# EasyEDA Pro project 3SE_24_Power_Rune.eprj, board Armour (continued)
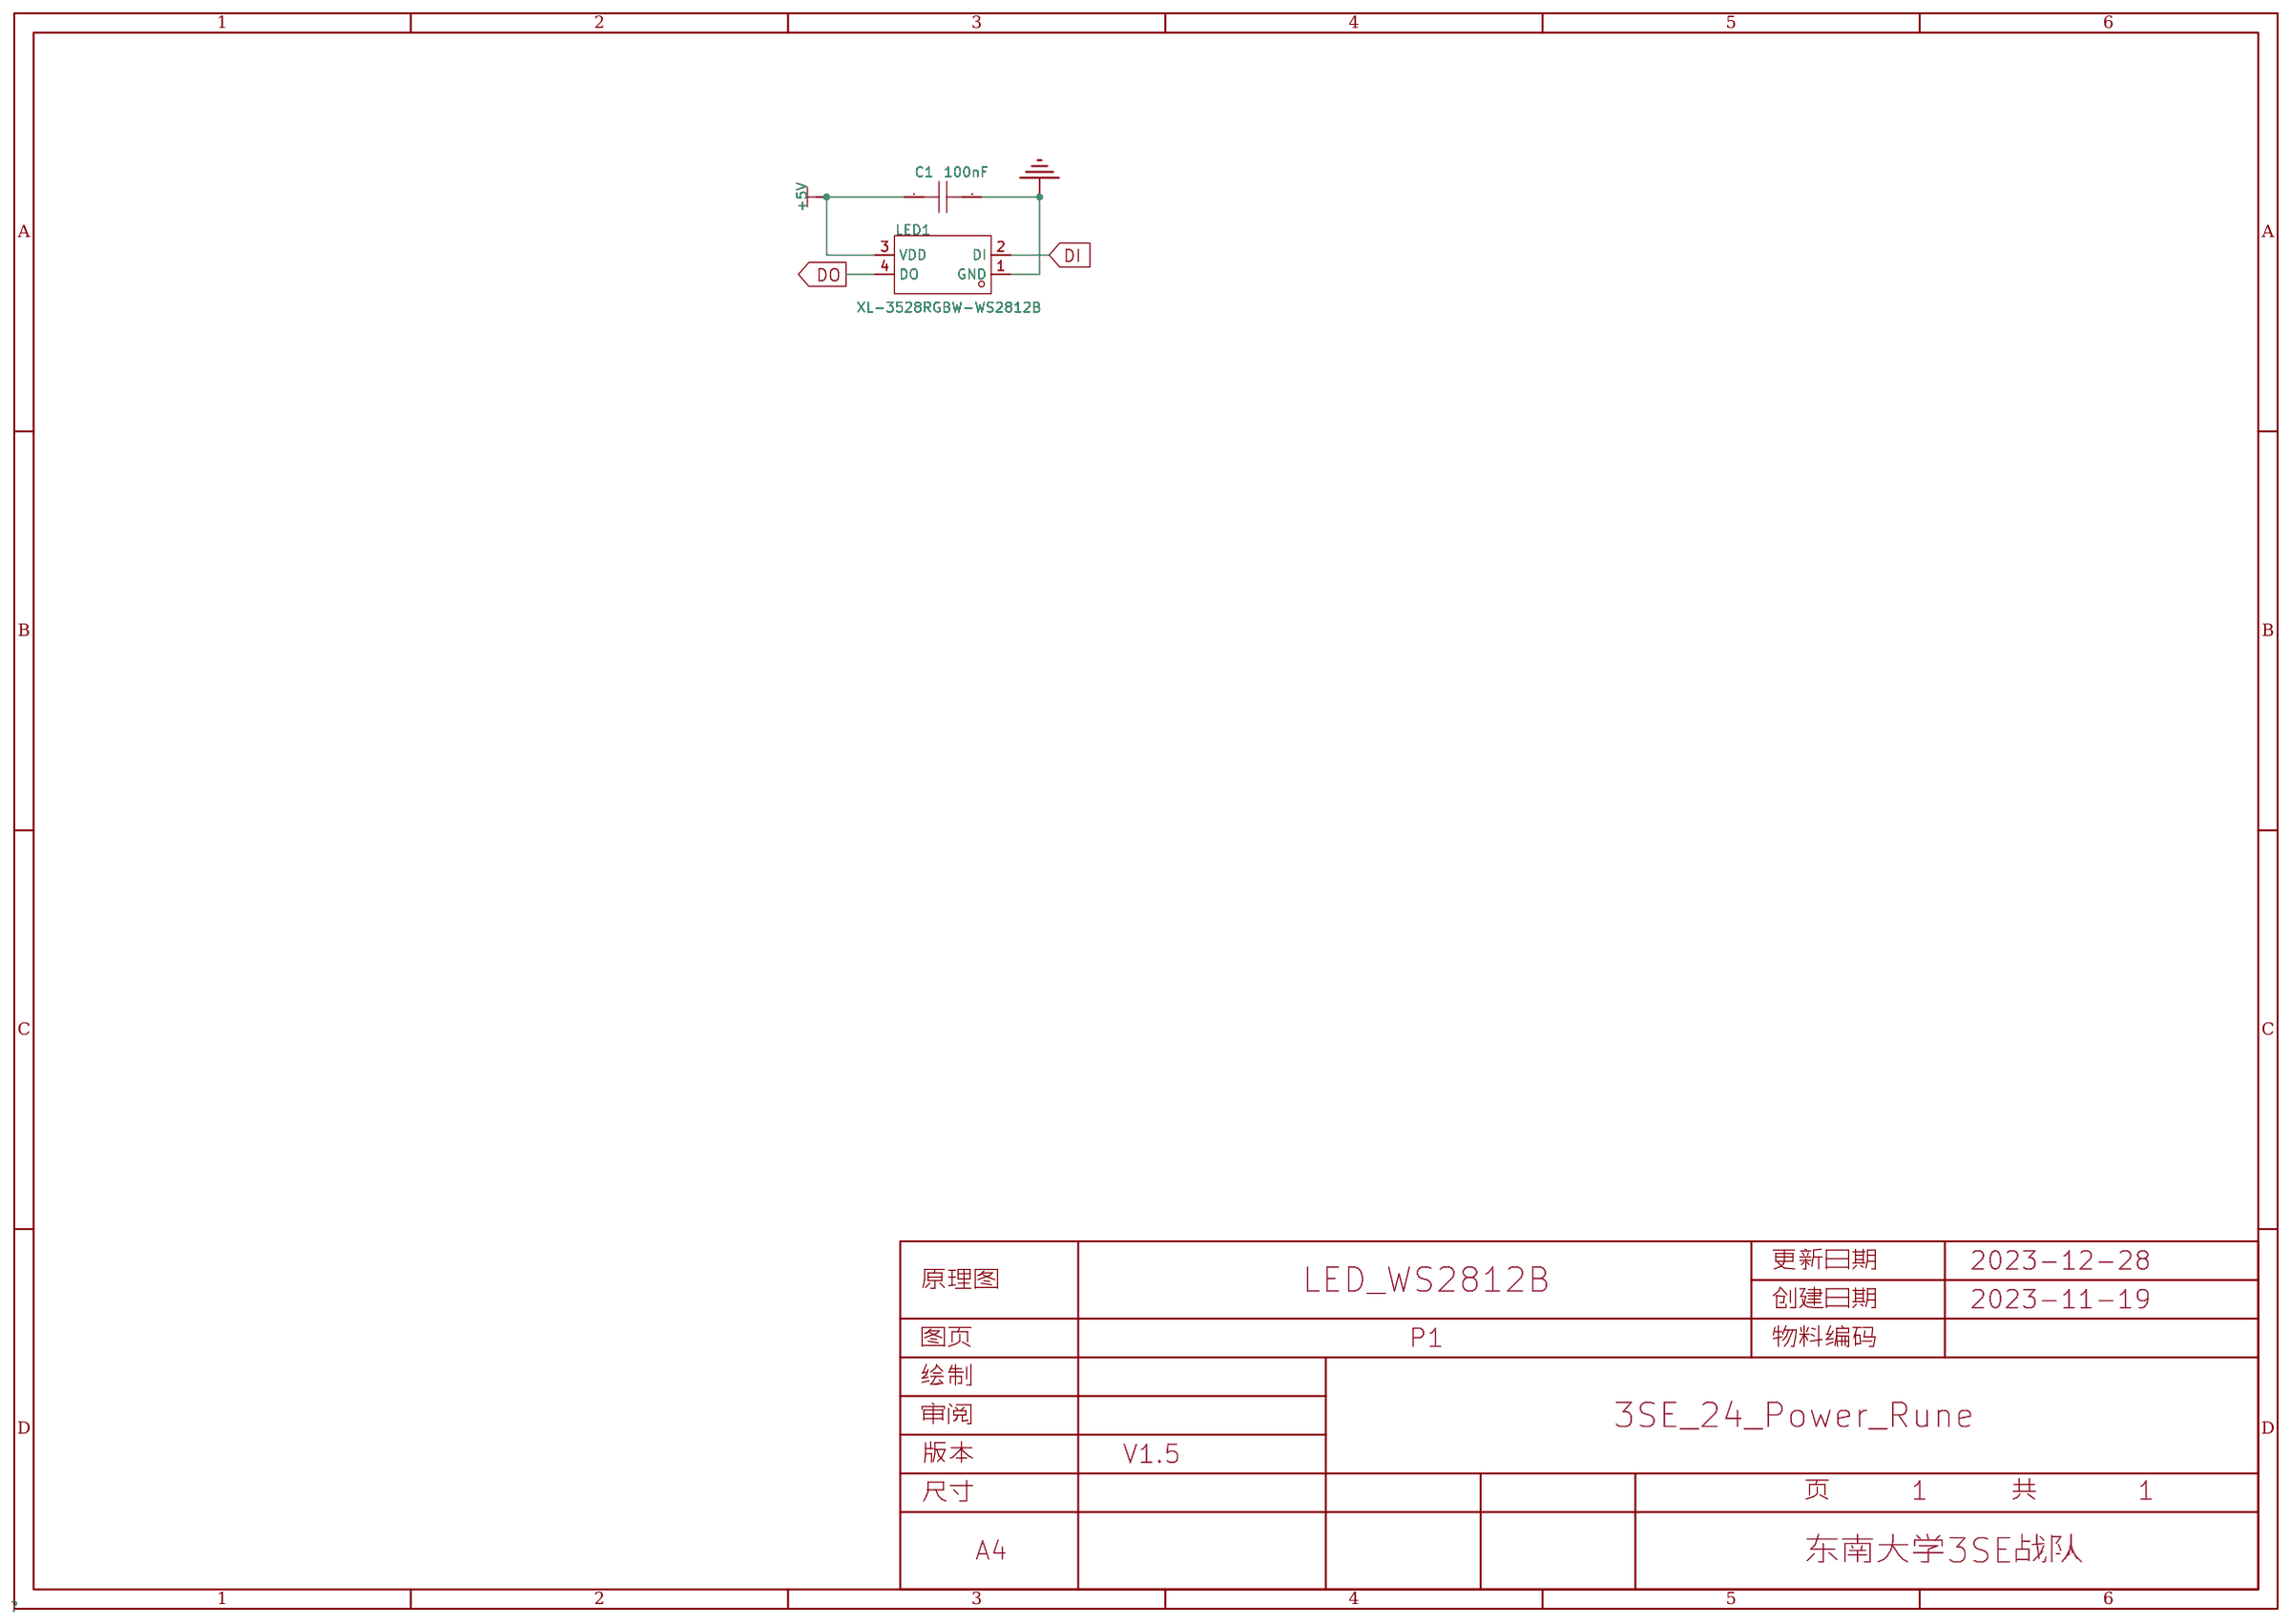
[diagram p0: schematic sheet]
## Placement (name value [footprint] x y rotation side) (continued)
SW3  DSHP01TSGER  [SW-SMD_DSHP01TSGER]  350.7 193.87 180 top
U1  XL4016E1  [TO-220-5_L15.5-W10.5-P1.70-BL_ON_CASE-314A-03]  24.2 212.38 180 top
U2  AMS1117-3.3  [SOT-223-4_L6.5-W3.5-P2.30-LS7.0-BR]  334.48 206.06 180 top
U3  ESP32-S3-WROOM-1-N8R2  [WIRELM-SMD_ESP32-S3-WROOM-1]  341.13 226.19 0 top
U4  74HC4051D,653  [SOIC-16_L9.9-W3.9-P1.27-LS6.0-BL]  341.79 196.72 0 top
USB1  TYPE-C 16PIN 2MD(073)  [USB-C-SMD_TYPE-C-6PIN-2MD-073]  350.37 207.98 90 top
X1  32.768kHz  [FC-135R_L3.2-W1.5]  330.35 225.43 270 top

## Footprints (pads in the part's own frame, mm; a bottom-side part is the same pattern mirrored in y, then rotated)
C0603
  rect 0.8x0.9 smd: 1(-0.7,0) 2(0.7,0)
CAP-SMD_BD10.0-L10.3-W10.3-LS11.0-FD
  rect 4.5x1.65 smd: 1(-4.5,0) 2(4.5,0)
CAP-SMD_BD12.5-L13.0-W13.0-RD
  rect 5x1.6 smd: 1(5.8,0) 2(-5.8,0)
CONN-SMD_2P-P1.25_HCTL_HC-GH-2PWTKK
  rect 0.7x1.8 smd: 1(-0.625,1.75) 2(0.625,1.75)
  rect 1x2.7 smd: 3(2.455,-1.75) 4(-2.455,-1.75)
CONN-SMD_4P-P1.25_XUNPU_WAFER-GH1.25-4PWB
  rect 0.6x1.7 smd: 1(-1.875,1.575) 2(-0.625,1.575) 3(0.625,1.575) 4(1.875,1.575)
  rect 1x2.8 smd: 5(3.725,-1.575) 6(-3.725,-1.575)
CONN-TH_SM03B-GHS-TB-LF-SN
  rect 0.6x1.7 smd: 1(-1.25,1.854) 2(0,1.854) 3(1.25,1.854)
  rect 1x2.2 smd: 4(3.1,-1.854) 5(-3.1,-1.854)
CONN-TH_SM03B-GHS-TB-LF-SN#2
  rect 0.6x1.7 smd: 1(-1.25,1.854) 2(0,1.854) 3(1.25,1.854)
  rect 1x2.2 smd: 4(3.1,-1.854) 5(-3.1,-1.854)
CONN-TH_XT30PW-F-1
  round 2.5 hole 1.7: 1(-2.5,2.5) 2(2.5,2.5)
  round 1.8 hole 1: 3(5.5,-2.5) 4(-5.5,-2.5)
CONN-TH_XT30PW-M
  round 2.5 hole 1.8: 1(-2.5,5) 2(2.5,5)
  round 1.8 hole 1.1: 3(5.5,-5) 4(-5.5,-5)
FC-135R_L3.2-W1.5
  rect 1x1.8 smd: 1(-1.25,0) 2(1.25,0)
IND-SMD_L17.5-W17.2
  rect 4x14 smd: 1(-8,0) 2(8,0)
LED0603-RD_RED
  rect 0.8x0.8 smd: 1(-0.799,-0.004) 2(0.799,0.004)
LED-SMD_4P-L3.5-W2.8-BR-1
  rect 1.2x0.9 smd: 1(1.5,-0.75) 2(1.5,0.75) 3(-1.5,0.75) 4(-1.5,-0.75)
R0603
  rect 0.806x0.864 smd: 1(-0.753,0) 2(0.753,0)
SMB_L4.6-W3.6-LS5.3-BI
  rect 2.047x2.241 smd: 1(-2.591,0) 2(2.591,0)
SOD-323_L1.7-W1.3-LS2.6-BI
  rect 0.83x0.63 smd: 1(-1.14,0) 2(1.14,0)
SOIC-16_L9.9-W3.9-P1.27-LS6.0-BL
  oval 0.602x1.971 smd: 1(-4.445,-2.736) 2(-3.175,-2.736) 3(-1.905,-2.736) 4(-0.635,-2.736) 5(0.635,-2.736) 6(1.905,-2.736) 7(3.175,-2.736) 8(4.445,-2.736) 9(4.445,2.736) 10(3.175,2.736) 11(1.905,2.736) 12(0.635,2.736) 13(-0.635,2.736) 14(-1.905,2.736) 15(-3.175,2.736) 16(-4.445,2.736)
SOT-23-6_L2.9-W1.6-P0.95-LS2.8-BL
  rect 0.532x1.072 smd: 1(-0.95,-1.149) 2(0,-1.149) 3(0.95,-1.149) 4(0.95,1.149) 5(0,1.149) 6(-0.95,1.149)
SOT-223-4_L6.5-W3.5-P2.30-LS7.0-BR
  rect 2.47x0.98 smd: 1(2.835,-2.3) 2(2.835,0) 3(2.835,2.3)
  rect 2.47x3.6 smd: 4(-2.835,0)
SW-SMD_DSHP01TSGER
  rect 0.76x1.27 smd: 1(0,3.81) 2(0,-3.81)
SW-SMD_L6.0-W3.3-LS8.0
  rect 1.9x1.5 smd: 1(-4,0) 2(4,0)
Test-Point-0.5mm
  round 0.5 smd: 1(0,0)
TO-220-5_L15.5-W10.5-P1.70-BL_ON_CASE-314A-03
  rect 1.8x1.8 hole 1.2: 1(-3.4,-9.45)
  round 1.8 hole 1.2: 2(-1.7,-5.35) 3(0,-9.45) 4(1.7,-5.35) 5(3.4,-9.45)
  round 4 hole 4: 6(0,9.45)
  rect 11x6.5 smd: 6(0,9.45)
TO-277_3P-L5.4-W4.0-LS6.5-TR
  rect 1.29x1.423 smd: 1(2.054,0.92) 3(2.054,-0.92)
  rect 5.2x3.8 smd: 2(-2.054,0)
USB-C-SMD_TYPE-C-6PIN-2MD-073
  rect 0.6x1.1 smd: 1(-3.2,2.375) 2(-2.4,2.375) 11(2.4,2.375) 12(3.2,2.375)
  rect 0.3x1.1 smd: 3(-1.75,2.375) 4(-1.25,2.375) 5(-0.75,2.375) 6(-0.25,2.375) 7(0.25,2.375) 8(0.75,2.375) 9(1.25,2.375) 10(1.75,2.375)
  oval 1.2x2 hole 0.6x1.5: 13(-4.325,1.825) 14(4.325,1.825)
  oval 1.2x1.8 hole 0.6x1.2: 13(-4.325,-2.375) 14(4.325,-2.375)
WIRELM-SMD_ESP32-S3-WROOM-1
  rect 1.5x0.9 smd: 1(-8.75,8.895) 2(-8.75,7.625) 3(-8.75,6.355) 4(-8.75,5.085) 5(-8.75,3.815) 6(-8.75,2.545) 7(-8.75,1.275) 8(-8.75,0.005) 9(-8.75,-1.265) 10(-8.75,-2.535) 11(-8.75,-3.805) 12(-8.75,-5.075) 13(-8.75,-6.345) 14(-8.75,-7.615) 27(8.75,-7.615) 28(8.75,-6.345) 29(8.75,-5.075) 30(8.75,-3.805) 31(8.75,-2.535) 32(8.75,-1.265) 33(8.75,0.005) 34(8.75,1.275) 35(8.75,2.545) 36(8.75,3.815) 37(8.75,5.085) 38(8.75,6.355) 39(8.75,7.625) 40(8.75,8.895)
  rect 0.9x1.5 smd: 15(-6.985,-8.895) 16(-5.715,-8.895) 17(-4.445,-8.895) 18(-3.175,-8.895) 19(-1.905,-8.895) 20(-0.635,-8.895) 21(0.635,-8.895) 22(1.905,-8.895) 23(3.175,-8.895) 24(4.445,-8.895) 25(5.715,-8.895) 26(6.985,-8.865)
  rect 0.9x0.9 smd: 41(-2.9,2.575) 41(-2.9,1.175) 41(-2.9,-0.225) 41(-1.5,2.575) 41(-1.5,1.175) 41(-1.5,-0.225) 41(-0.1,2.575) 41(-0.1,1.175) 41(-0.1,-0.225)
热插拔轴座
  rect 1.981x1.981 smd far side: 1(-5.995,-5.055) 2(7.466,-2.515)
  round 3.304 hole 3: 1(-2.439,-5.056) 2(3.91,-2.515)

## Nets
+3V3: 3V3.1 C434.1 C435.2 C445.1 C446.1 C448.1 R2.2 R3.2 R5.2 R8.2 R11.2 R12.2 R14.2 R17.2 R18.1 R25.2 R26.2 R28.1 R30.2 R31.1 U2.2 U2.4 U3.2 U4.16
+5V: 5V.1 C1.1 C2.1 C3.1 C4.1 C5.1 C6.1 C7.1 C8.1 C9.1 C10.1 C11.1 C12.1 C13.1 C14.1 C15.1 C16.1 C17.1 C18.1 C19.1 C20.1 C21.1 C22.1 C23.1 C24.1 C25.1 C26.1 C27.1 C28.1 C29.1 C30.1 C31.1 C32.1 C33.1 C34.1 C35.1 C36.1 C37.1 C38.1 C39.1 C40.1 C41.1 C42.1 C43.1 C44.1 C45.1 C46.1 C47.1 C48.1 C49.1 C50.1 C51.1 C52.1 C53.1 C54.1 C55.1 C56.1 C57.1 C58.1 C59.1 C60.1 C61.1 C62.1 C63.1 C64.1 C65.1 C66.1 C67.1 C68.1 C69.1 C70.1 C71.1 C72.1 C73.1 C74.1 C75.1 C76.1 C77.1 C78.1 C79.1 C80.1 C81.1 C82.1 C83.1 C84.1 C85.1 C86.1 C87.1 C88.1 C89.1 C90.1 C91.1 C92.1 C93.1 C94.1 C95.1 C96.1 C97.1 C98.1 C99.1 C100.1 C101.1 C102.1 C103.1 C104.1 C105.1 C106.1 C107.1 C108.1 C109.1 C110.1 C111.1 C112.1 C113.1 C114.1 C115.1 C116.1 C117.1 C118.1 C119.1 C120.1 C121.1 C122.1 C123.1 C124.1 C125.1 C126.1 C127.1 C128.1 C129.1 C130.1 C131.1 C132.1 C133.1 C134.1 C135.1 C136.1 C137.1 C138.1 C139.1 C140.1 C141.1 C142.1 C143.1 C144.1 C145.1 C146.1 C147.1 C148.1 C149.1 C150.1 C151.1 C152.1 C153.1 C154.1 C155.1 C156.1 C157.1 C158.1 C159.1 C160.1 C161.1 C162.1 C163.1 C164.1 C165.1 C166.1 C167.1 C168.1 C169.1 C170.1 C171.1 C172.1 C173.1 C174.1 C175.1 C176.1 C177.1 C178.1 C179.1 C180.1 C181.1 C182.1 C183.1 C184.1 C185.1 C186.1 C187.1 C188.1 C189.1 C190.1 C191.1 C192.1 C193.1 C194.1 C195.1 C196.1 C197.1 C198.1 C199.1 C200.1 C201.1 C202.1 C203.1 C204.1 C205.1 C206.1 C207.1 C208.1 C209.1 C210.1 C211.1 C212.1 C213.1 C214.1 C215.1 C216.1 C217.1 C218.1 C219.1 C220.1 C221.1 C222.1 C223.1 C224.1 C225.1 C226.1 C227.1 C228.1 C229.1 C230.1 C231.1 C232.1 C233.1 C234.1 C235.1 C236.1 C237.1 C238.1 C239.1 C240.1 C241.1 C242.1 C243.1 C244.1 C245.1 C246.1 C247.1 C248.1 C249.1 C250.1 C251.1 C252.1 C253.1 C254.1 C255.1 C256.1 C257.1 C258.1 C259.1 C260.1 C261.1 C262.1 C263.1 C264.1 C265.1 C266.1 C267.1 C268.1 C269.1 C270.1 C271.1 C272.1 C273.1 C274.1 C275.1 C276.1 C277.1 C278.1 C279.1 C280.1 C281.1 C282.1 C283.1 C284.1 C285.1 C286.1 C287.1 C288.1 C289.1 C290.1 C291.1 C292.1 C293.1 C294.1 C295.1 C296.1 C297.1 C298.1 C299.1 C300.1 C301.1 C302.1 C303.1 C304.1 C305.1 C306.1 C307.1 C308.1 C309.1 C310.1 C311.1 C312.1 C313.1 C314.1 C315.1 C316.1 C317.1 C318.1 C319.1 C320.1 C321.1 C322.1 C323.1 C324.1 C325.1 C326.1 C327.1 C328.1 C329.1 C330.1 C331.1 C332.1 C333.1 C334.1 C335.1 C336.1 C337.1 C338.1 C339.1 C340.1 C341.1 C342.1 C343.1 C344.1 C345.1 C346.1 C347.1 C348.1 C349.1 C350.1 C351.1 C352.1 C353.1 C354.1 C355.1 C356.1 C357.1 C358.1 C359.1 C360.1 C361.1 C362.1 C363.1 C364.1 C365.1 C366.1 C367.1 C368.1 C369.1 C370.1 C371.1 C372.1 C373.1 C374.1 C375.1 C376.1 C377.1 C378.1 C379.1 C380.1 C381.1 C382.1 C383.1 C384.1 C385.1 C386.1 C387.1 C388.1 C389.1 C390.1 C391.1 C392.1 C393.1 C394.1 C395.1 C396.1 C397.1 C398.1 C399.1 C400.1 C401.1 C402.1 C403.1 C404.1 C405.1 C406.1 C407.1 C408.1 C409.1 C410.1 C411.1 C412.1 C413.1 C414.1 C415.1 C416.1 C417.1 C418.1 C419.1 C420.1 C421.1 C422.1 C423.1 C424.1 C425.1 C426.1 C427.1 C428.1 C429.1 C430.1 C436.1 C437.2 C438.2 C439.1 C440.2 C458.1 C459.1 C460.1 C461.1 C462.1 C463.1 CN2.1 CN3.1 CN5.1 CN6.4 D3.2 D4.5 L1.2 LED1.3 LED2.3 LED3.3 LED4.3 LED5.3 LED6.3 LED7.3 LED8.3 LED9.3 LED10.3 LED11.3 LED12.3 LED13.3 LED14.3 LED15.3 LED16.3 LED17.3 LED18.3 LED19.3 LED20.3 LED21.3 LED22.3 LED23.3 LED24.3 LED25.3 LED26.3 LED27.3 LED28.3 LED29.3 LED30.3 LED31.3 LED32.3 LED33.3 LED34.3 LED35.3 LED36.3 LED37.3 LED38.3 LED39.3 LED40.3 LED41.3 LED42.3 LED43.3 LED44.3 LED45.3 LED46.3 LED47.3 LED48.3 LED49.3 LED50.3 LED51.3 LED52.3 LED53.3 LED54.3 LED55.3 LED56.3 LED57.3 LED58.3 LED59.3 LED60.3 LED61.3 LED62.3 LED63.3 LED64.3 LED65.3 LED66.3 LED67.3 LED68.3 LED69.3 LED70.3 LED71.3 LED72.3 LED73.3 LED74.3 LED75.3 LED76.3 LED77.3 LED78.3 LED79.3 LED80.3 LED81.3 LED82.3 LED83.3 LED84.3 LED85.3 LED86.3 LED87.3 LED88.3 LED89.3 LED90.3 LED91.3 LED92.3 LED93.3 LED94.3 LED95.3 LED96.3 LED97.3 LED98.3 LED99.3 LED100.3 LED101.3 LED102.3 LED103.3 LED104.3 LED105.3 LED106.3 LED107.3 LED108.3 LED109.3 LED110.3 LED111.3 LED112.3 LED113.3 LED114.3 LED115.3 LED116.3 LED117.3 LED118.3 LED119.3 LED120.3 LED121.3 LED122.3 LED123.3 LED124.3 LED125.3 LED126.3 LED127.3 LED128.3 LED129.3 LED130.3 LED131.3 LED132.3 LED133.3 LED134.3 LED135.3 LED136.3 LED137.3 LED138.3 LED139.3 LED140.3 LED141.3 LED142.3 LED143.3 LED144.3 LED145.3 LED146.3 LED147.3 LED148.3 LED149.3 LED150.3 LED151.3 LED152.3 LED153.3 LED154.3 LED155.3 LED156.3 LED157.3 LED158.3 LED159.3 LED160.3 LED161.3 LED162.3 LED163.3 LED164.3 LED165.3 LED166.3 LED167.3 LED168.3 LED169.3 LED170.3 LED171.3 LED172.3 LED173.3 LED174.3 LED175.3 LED176.3 LED177.3 LED178.3 LED179.3 LED180.3 LED181.3 LED182.3 LED183.3 LED184.3 LED185.3 LED186.3 LED187.3 LED188.3 LED189.3 LED190.3 LED191.3 LED192.3 LED193.3 LED194.3 LED195.3 LED196.3 LED197.3 LED198.3 LED199.3 LED200.3 LED201.3 LED202.3 LED203.3 LED204.3 LED205.3 LED206.3 LED207.3 LED208.3 LED209.3 LED210.3 LED211.3 LED212.3 LED213.3 LED214.3 LED215.3 LED216.3 LED217.3 LED218.3 LED219.3 LED220.3 LED221.3 LED222.3 LED223.3 LED224.3 LED225.3 LED226.3 LED227.3 LED228.3 LED229.3 LED230.3 LED231.3 LED232.3 LED233.3 LED234.3 LED235.3 LED236.3 LED237.3 LED238.3 LED239.3 LED240.3 LED241.3 LED242.3 LED243.3 LED244.3 LED245.3 LED246.3 LED247.3 LED248.3 LED249.3 LED250.3 LED251.3 LED252.3 LED253.3 LED254.3 LED255.3 LED256.3 LED257.3 LED258.3 LED259.3 LED260.3 LED261.3 LED262.3 LED263.3 LED264.3 LED265.3 LED266.3 LED267.3 LED268.3 LED269.3 LED270.3 LED271.3 LED272.3 LED273.3 LED274.3 LED275.3 LED276.3 LED277.3 LED278.3 LED279.3 LED280.3 LED281.3 LED282.3 LED283.3 LED284.3 LED285.3 LED286.3 LED287.3 LED288.3 LED289.3 LED290.3 LED291.3 LED292.3 LED293.3 LED294.3 LED295.3 LED296.3 LED297.3 LED298.3 LED299.3 LED300.3 LED301.3 LED302.3 LED303.3 LED304.3 LED305.3 LED306.3 LED307.3 LED308.3 LED309.3 LED310.3 LED311.3 LED312.3 LED313.3 LED314.3 LED315.3 LED316.3 LED317.3 LED318.3 LED319.3 LED320.3 LED321.3 LED322.3 LED323.3 LED324.3 LED325.3 LED326.3 LED327.3 LED328.3 LED329.3 LED330.3 LED331.3 LED332.3 LED333.3 LED334.3 LED335.3 LED336.3 LED337.3 LED338.3 LED339.3 LED340.3 LED341.3 LED342.3 LED343.3 LED344.3 LED345.3 LED346.3 LED347.3 LED348.3 LED349.3 LED350.3 LED351.3 LED352.3 LED353.3 LED354.3 LED355.3 LED356.3 LED357.3 LED358.3 LED359.3 LED360.3 LED361.3 LED362.3 LED363.3 LED364.3 LED365.3 LED366.3 LED367.3 LED368.3 LED369.3 LED370.3 LED371.3 LED372.3 LED373.3 LED374.3 LED375.3 LED376.3 LED377.3 LED378.3 LED379.3 LED380.3 LED381.3 LED382.3 LED383.3 LED384.3 LED385.3 LED386.3 LED387.3 LED388.3 LED389.3 LED390.3 LED391.3 LED392.3 LED393.3 LED394.3 LED395.3 LED396.3 LED397.3 LED398.3 LED399.3 LED400.3 LED401.3 LED402.3 LED403.3 LED404.3 LED405.3 LED406.3 LED407.3 LED408.3 LED409.3 LED410.3 LED411.3 LED412.3 LED413.3 LED414.3 LED415.3 LED416.3 LED417.3 LED418.3 LED419.3 LED420.3 LED421.3 LED422.3 LED423.3 LED424.3 LED425.3 LED426.3 LED427.3 LED428.3 LED429.3 LED430.3 LED432.3 LED433.3 LED434.3 LED435.3 LED436.3 LED437.3 R1.2 U2.3 USB1.2 USB1.11
+24V: 24V.1 C431.2 C432.1 C433.2 CN1.2 D1.2 U1.5
GND: C1.2 C2.2 C3.2 C4.2 C5.2 C6.2 C7.2 C8.2 C9.2 C10.2 C11.2 C12.2 C13.2 C14.2 C15.2 C16.2 C17.2 C18.2 C19.2 C20.2 C21.2 C22.2 C23.2 C24.2 C25.2 C26.2 C27.2 C28.2 C29.2 C30.2 C31.2 C32.2 C33.2 C34.2 C35.2 C36.2 C37.2 C38.2 C39.2 C40.2 C41.2 C42.2 C43.2 C44.2 C45.2 C46.2 C47.2 C48.2 C49.2 C50.2 C51.2 C52.2 C53.2 C54.2 C55.2 C56.2 C57.2 C58.2 C59.2 C60.2 C61.2 C62.2 C63.2 C64.2 C65.2 C66.2 C67.2 C68.2 C69.2 C70.2 C71.2 C72.2 C73.2 C74.2 C75.2 C76.2 C77.2 C78.2 C79.2 C80.2 C81.2 C82.2 C83.2 C84.2 C85.2 C86.2 C87.2 C88.2 C89.2 C90.2 C91.2 C92.2 C93.2 C94.2 C95.2 C96.2 C97.2 C98.2 C99.2 C100.2 C101.2 C102.2 C103.2 C104.2 C105.2 C106.2 C107.2 C108.2 C109.2 C110.2 C111.2 C112.2 C113.2 C114.2 C115.2 C116.2 C117.2 C118.2 C119.2 C120.2 C121.2 C122.2 C123.2 C124.2 C125.2 C126.2 C127.2 C128.2 C129.2 C130.2 C131.2 C132.2 C133.2 C134.2 C135.2 C136.2 C137.2 C138.2 C139.2 C140.2 C141.2 C142.2 C143.2 C144.2 C145.2 C146.2 C147.2 C148.2 C149.2 C150.2 C151.2 C152.2 C153.2 C154.2 C155.2 C156.2 C157.2 C158.2 C159.2 C160.2 C161.2 C162.2 C163.2 C164.2 C165.2 C166.2 C167.2 C168.2 C169.2 C170.2 C171.2 C172.2 C173.2 C174.2 C175.2 C176.2 C177.2 C178.2 C179.2 C180.2 C181.2 C182.2 C183.2 C184.2 C185.2 C186.2 C187.2 C188.2 C189.2 C190.2 C191.2 C192.2 C193.2 C194.2 C195.2 C196.2 C197.2 C198.2 C199.2 C200.2 C201.2 C202.2 C203.2 C204.2 C205.2 C206.2 C207.2 C208.2 C209.2 C210.2 C211.2 C212.2 C213.2 C214.2 C215.2 C216.2 C217.2 C218.2 C219.2 C220.2 C221.2 C222.2 C223.2 C224.2 C225.2 C226.2 C227.2 C228.2 C229.2 C230.2 C231.2 C232.2 C233.2 C234.2 C235.2 C236.2 C237.2 C238.2 C239.2 C240.2 C241.2 C242.2 C243.2 C244.2 C245.2 C246.2 C247.2 C248.2 C249.2 C250.2 C251.2 C252.2 C253.2 C254.2 C255.2 C256.2 C257.2 C258.2 C259.2 C260.2 C261.2 C262.2 C263.2 C264.2 C265.2 C266.2 C267.2 C268.2 C269.2 C270.2 C271.2 C272.2 C273.2 C274.2 C275.2 C276.2 C277.2 C278.2 C279.2 C280.2 C281.2 C282.2 C283.2 C284.2 C285.2 C286.2 C287.2 C288.2 C289.2 C290.2 C291.2 C292.2 C293.2 C294.2 C295.2 C296.2 C297.2 C298.2 C299.2 C300.2 C301.2 C302.2 C303.2 C304.2 C305.2 C306.2 C307.2 C308.2 C309.2 C310.2 C311.2 C312.2 C313.2 C314.2 C315.2 C316.2 C317.2 C318.2 C319.2 C320.2 C321.2 C322.2 C323.2 C324.2 C325.2 C326.2 C327.2 C328.2 C329.2 C330.2 C331.2 C332.2 C333.2 C334.2 C335.2 C336.2 C337.2 C338.2 C339.2 C340.2 C341.2 C342.2 C343.2 C344.2 C345.2 C346.2 C347.2 C348.2 C349.2 C350.2 C351.2 C352.2 C353.2 C354.2 C355.2 C356.2 C357.2 C358.2 C359.2 C360.2 C361.2 C362.2 C363.2 C364.2 C365.2 C366.2 C367.2 C368.2 C369.2 C370.2 C371.2 C372.2 C373.2 C374.2 C375.2 C376.2 C377.2 C378.2 C379.2 C380.2 C381.2 C382.2 C383.2 C384.2 C385.2 C386.2 C387.2 C388.2 C389.2 C390.2 C391.2 C392.2 C393.2 C394.2 C395.2 C396.2 C397.2 C398.2 C399.2 C400.2 C401.2 C402.2 C403.2 C404.2 C405.2 C406.2 C407.2 C408.2 C409.2 C410.2 C411.2 C412.2 C413.2 C414.2 C415.2 C416.2 C417.2 C418.2 C419.2 C420.2 C421.2 C422.2 C423.2 C424.2 C425.2 C426.2 C427.2 C428.2 C429.2 C430.2 C431.1 C432.2 C434.2 C435.1 C436.2 C437.1 C439.2 C440.1 C441.1 C442.1 C443.1 C444.1 C445.2 C446.2 C447.1 C448.2 C449.1 C450.2 C451.1 C452.2 C453.1 C454.2 C456.1 C457.1 C458.2 C459.2 C460.2 C461.2 C462.2 C463.2 CN1.1 CN1.3 CN1.4 CN2.2 CN2.4 CN2.5 CN3.2 CN3.4 CN3.5 CN4.1 CN4.3 CN4.4 CN5.2 CN5.3 CN5.4 CN6.3 CN6.5 CN6.6 D1.1 D2.1 D2.3 D3.1 D4.2 KEY1.1 KEY2.1 KEY3.1 KEY4.1 KEY5.1 KEY6.1 KEY7.1 KEY8.1 KEY9.1 KEY10.1 KEY11.1 KEY12.1 KEY13.1 KEY14.1 KEY15.1 KEY16.1 KEY17.1 KEY18.1 KEY19.1 KEY20.1 KEY21.1 KEY22.1 KEY23.1 KEY24.1 KEY25.1 KEY26.1 KEY27.1 KEY28.1 KEY29.1 KEY30.1 KEY31.1 KEY32.1 KEY33.1 KEY34.1 KEY35.1 KEY36.1 KEY37.1 KEY38.1 KEY39.1 KEY40.1 KEY41.1 KEY42.1 KEY43.1 KEY44.1 KEY45.1 KEY46.1 KEY47.1 KEY48.1 KEY49.1 KEY50.1 KEY51.1 LED1.1 LED2.1 LED3.1 LED4.1 LED5.1 LED6.1 LED7.1 LED8.1 LED9.1 LED10.1 LED11.1 LED12.1 LED13.1 LED14.1 LED15.1 LED16.1 LED17.1 LED18.1 LED19.1 LED20.1 LED21.1 LED22.1 LED23.1 LED24.1 LED25.1 LED26.1 LED27.1 LED28.1 LED29.1 LED30.1 LED31.1 LED32.1 LED33.1 LED34.1 LED35.1 LED36.1 LED37.1 LED38.1 LED39.1 LED40.1 LED41.1 LED42.1 LED43.1 LED44.1 LED45.1 LED46.1 LED47.1 LED48.1 LED49.1 LED50.1 LED51.1 LED52.1 LED53.1 LED54.1 LED55.1 LED56.1 LED57.1 LED58.1 LED59.1 LED60.1 LED61.1 LED62.1 LED63.1 LED64.1 LED65.1 LED66.1 LED67.1 LED68.1 LED69.1 LED70.1 LED71.1 LED72.1 LED73.1 LED74.1 LED75.1 LED76.1 LED77.1 LED78.1 LED79.1 LED80.1 LED81.1 LED82.1 LED83.1 LED84.1 LED85.1 LED86.1 LED87.1 LED88.1 LED89.1 LED90.1 LED91.1 LED92.1 LED93.1 LED94.1 LED95.1 LED96.1 LED97.1 LED98.1 LED99.1 LED100.1 LED101.1 LED102.1 LED103.1 LED104.1 LED105.1 LED106.1 LED107.1 LED108.1 LED109.1 LED110.1 LED111.1 LED112.1 LED113.1 LED114.1 LED115.1 LED116.1 LED117.1 LED118.1 LED119.1 LED120.1 LED121.1 LED122.1 LED123.1 LED124.1 LED125.1 LED126.1 LED127.1 LED128.1 LED129.1 LED130.1 LED131.1 LED132.1 LED133.1 LED134.1 LED135.1 LED136.1 LED137.1 LED138.1 LED139.1 LED140.1 LED141.1 LED142.1 LED143.1 LED144.1 LED145.1 LED146.1 LED147.1 LED148.1 LED149.1 LED150.1 LED151.1 LED152.1 LED153.1 LED154.1 LED155.1 LED156.1 LED157.1 LED158.1 LED159.1 LED160.1 LED161.1 LED162.1 LED163.1 LED164.1 LED165.1 LED166.1 LED167.1 LED168.1 LED169.1 LED170.1 LED171.1 LED172.1 LED173.1 LED174.1 LED175.1 LED176.1 LED177.1 LED178.1 LED179.1 LED180.1 LED181.1 LED182.1 LED183.1 LED184.1 LED185.1 LED186.1 LED187.1 LED188.1 LED189.1 LED190.1 LED191.1 LED192.1 LED193.1 LED194.1 LED195.1 LED196.1 LED197.1 LED198.1 LED199.1 LED200.1 LED201.1 LED202.1 LED203.1 LED204.1 LED205.1 LED206.1 LED207.1 LED208.1 LED209.1 LED210.1 LED211.1 LED212.1 LED213.1 LED214.1 LED215.1 LED216.1 LED217.1 LED218.1 LED219.1 LED220.1 LED221.1 LED222.1 LED223.1 LED224.1 LED225.1 LED226.1 LED227.1 LED228.1 LED229.1 LED230.1 LED231.1 LED232.1 LED233.1 LED234.1 LED235.1 LED236.1 LED237.1 LED238.1 LED239.1 LED240.1 LED241.1 LED242.1 LED243.1 LED244.1 LED245.1 LED246.1 LED247.1 LED248.1 LED249.1 LED250.1 LED251.1 LED252.1 LED253.1 LED254.1 LED255.1 LED256.1 LED257.1 LED258.1 LED259.1 LED260.1 LED261.1 LED262.1 LED263.1 LED264.1 LED265.1 LED266.1 LED267.1 LED268.1 LED269.1 LED270.1 LED271.1 LED272.1 LED273.1 LED274.1 LED275.1 LED276.1 LED277.1 LED278.1 LED279.1 LED280.1 LED281.1 LED282.1 LED283.1 LED284.1 LED285.1 LED286.1 LED287.1 LED288.1 LED289.1 LED290.1 LED291.1 LED292.1 LED293.1 LED294.1 LED295.1 LED296.1 LED297.1 LED298.1 LED299.1 LED300.1 LED301.1 LED302.1 LED303.1 LED304.1 LED305.1 LED306.1 LED307.1 LED308.1 LED309.1 LED310.1 LED311.1 LED312.1 LED313.1 LED314.1 LED315.1 LED316.1 LED317.1 LED318.1 LED319.1 LED320.1 LED321.1 LED322.1 LED323.1 LED324.1 LED325.1 LED326.1 LED327.1 LED328.1 LED329.1 LED330.1 LED331.1 LED332.1 LED333.1 LED334.1 LED335.1 LED336.1 LED337.1 LED338.1 LED339.1 LED340.1 LED341.1 LED342.1 LED343.1 LED344.1 LED345.1 LED346.1 LED347.1 LED348.1 LED349.1 LED350.1 LED351.1 LED352.1 LED353.1 LED354.1 LED355.1 LED356.1 LED357.1 LED358.1 LED359.1 LED360.1 LED361.1 LED362.1 LED363.1 LED364.1 LED365.1 LED366.1 LED367.1 LED368.1 LED369.1 LED370.1 LED371.1 LED372.1 LED373.1 LED374.1 LED375.1 LED376.1 LED377.1 LED378.1 LED379.1 LED380.1 LED381.1 LED382.1 LED383.1 LED384.1 LED385.1 LED386.1 LED387.1 LED388.1 LED389.1 LED390.1 LED391.1 LED392.1 LED393.1 LED394.1 LED395.1 LED396.1 LED397.1 LED398.1 LED399.1 LED400.1 LED401.1 LED402.1 LED403.1 LED404.1 LED405.1 LED406.1 LED407.1 LED408.1 LED409.1 LED410.1 LED411.1 LED412.1 LED413.1 LED414.1 LED415.1 LED416.1 LED417.1 LED418.1 LED419.1 LED420.1 LED421.1 LED422.1 LED423.1 LED424.1 LED425.1 LED426.1 LED427.1 LED428.1 LED429.1 LED430.1 LED432.1 LED433.1 LED434.1 LED435.1 LED436.1 LED437.1 R6.1 R15.1 R20.1 R22.1 R23.1 R24.1 R32.1 R33.1 SW1.2 SW2.2 U1.1 U2.1 U3.1 U3.40 U3.41 U4.7 U4.8 USB1.1 USB1.12 USB1.13 USB1.14
$1I32193/DO: LED258.4
$12I1626/DO: LED344.4
$12I6178/DO: LED437.4
BOOT: SW2.1 U3.27
DIN: U3.19 U4.3
DIN0: LED1.2 R23.2 U4.13
DIN1: LED259.2 R22.2 U4.14
DIN2: LED345.2 R20.2 U4.15
DIN3: CN2.3 R24.2 U4.12
DIN4: CN4.2 R15.2 U4.1
DN: D4.6 U3.13
DP: D4.4 U3.14
KEY1: KEY44.2 KEY45.2 KEY46.2 KEY47.2 KEY48.2 KEY49.2 KEY50.2 KEY51.2 R4.1
KEY1_IN: C441.2 R2.1 R4.2 U3.39
KEY2: KEY36.2 KEY37.2 KEY38.2 KEY39.2 KEY40.2 KEY41.2 KEY42.2 KEY43.2 R7.1
KEY2_IN: C442.2 R3.1 R7.2 U3.38
KEY3: KEY28.2 KEY29.2 KEY30.2 KEY31.2 KEY32.2 KEY33.2 KEY34.2 KEY35.2 R9.1
KEY3_IN: C443.2 R5.1 R9.2 U3.4
KEY4: KEY20.2 KEY21.2 KEY22.2 KEY23.2 KEY24.2 KEY25.2 KEY26.2 KEY27.2 R10.1
KEY4_IN: C444.2 R8.1 R10.2 U3.5
KEY5: KEY16.2 KEY17.2 KEY18.2 KEY19.2 R13.1
KEY5_IN: C447.2 R11.1 R13.2 U3.6
KEY6: KEY12.2 KEY13.2 KEY14.2 KEY15.2 R16.1
KEY6_IN: C449.2 R12.1 R16.2 U3.7
KEY7: KEY8.2 KEY9.2 KEY10.2 KEY11.2 R19.1
KEY7_IN: C451.2 R14.1 R19.2 U3.18
KEY8: KEY4.2 KEY5.2 KEY6.2 KEY7.2 R21.1
KEY8_IN: C453.2 R17.1 R21.2 U3.20
KEY9: KEY2.2 KEY3.2 R27.1
KEY9_IN: C456.2 R25.1 R27.2 U3.12
KEY10: KEY1.2 R29.1
KEY10_IN: C457.2 R26.1 R29.2 U3.17
RST: C450.1 R18.2 SW1.1 U3.3
RX: CN6.1 U3.36
TX: CN6.2 U3.37
~CS0: U3.22 U4.11
~CS1: U3.23 U4.10
~CS2: U3.31 U4.9
~EN_DEMUX: R31.2 SW3.1 U4.6
$1N25359: LED1.4 LED2.2
$1N25361: LED2.4 LED3.2
$1N25595: LED4.4 LED5.2
$1N25596: LED5.4 LED6.2
$1N25597: LED6.4 LED7.2
$1N25653: LED7.4 LED8.2
$1N25862: LED10.4 LED11.2
$1N25863: LED11.4 LED12.2
$1N25864: LED12.4 LED13.2
$1N25867: LED14.4 LED15.2
$1N25868: LED15.4 LED16.2
$1N25872: LED17.4 LED18.2
$1N25874: LED16.4 LED17.2
$1N25878: LED9.4 LED10.2
$1N26013: LED19.4 LED20.2
$1N26014: LED20.4 LED21.2
$1N26015: LED21.4 LED22.2
$1N26019: LED24.4 LED25.2
$1N26021: LED22.4 LED23.2
$1N26023: LED26.4 LED27.2
$1N26024: LED27.4 LED28.2
$1N26025: LED25.4 LED26.2
$1N26164: LED29.4 LED30.2
$1N26165: LED30.4 LED31.2
$1N26167: LED32.4 LED33.2
$1N26171: LED31.4 LED32.2
$1N26173: LED35.4 LED36.2
$1N26174: LED36.4 LED37.2
$1N26175: LED34.4 LED35.2
$1N26315: LED39.4 LED40.2
$1N26317: LED41.4 LED42.2
$1N26318: LED42.4 LED43.2
$1N26319: LED43.4 LED44.2
$1N26321: LED40.4 LED41.2
$1N26323: LED45.4 LED46.2
$1N26324: LED46.4 LED47.2
$1N26325: LED44.4 LED45.2
$1N26327: LED37.4 LED38.2
$1N26463: LED48.4 LED49.2
$1N26464: LED49.4 LED50.2
$1N26465: LED50.4 LED51.2
$1N26467: LED52.4 LED53.2
$1N26468: LED53.4 LED54.2
$1N26471: LED51.4 LED52.2
$1N26473: LED55.4 LED56.2
$1N26474: LED56.4 LED57.2
$1N26477: LED47.4 LED48.2
$1N26613: LED58.4 LED59.2
$1N26614: LED59.4 LED60.2
$1N26615: LED60.4 LED61.2
$1N26617: LED62.4 LED63.2
$1N26618: LED63.4 LED64.2
$1N26619: LED64.4 LED65.2
$1N26621: LED61.4 LED62.2
$1N26623: LED66.4 LED67.2
$1N26624: LED67.4 LED68.2
$1N26625: LED65.4 LED66.2
$1N26627: LED57.4 LED58.2
$1N26763: LED69.4 LED70.2
$1N26767: LED72.4 LED73.2
$1N26768: LED73.4 LED74.2
$1N26769: LED74.4 LED75.2
$1N26771: LED71.4 LED72.2
$1N26773: LED76.4 LED77.2
$1N26774: LED77.4 LED78.2
$1N26775: LED75.4 LED76.2
$1N26777: LED68.4 LED69.2
$1N26913: LED79.4 LED80.2
$1N26917: LED82.4 LED83.2
$1N26918: LED83.4 LED84.2
$1N26919: LED84.4 LED85.2
$1N26921: LED81.4 LED82.2
$1N26923: LED86.4 LED87.2
$1N26924: LED87.4 LED88.2
$1N26925: LED85.4 LED86.2
$1N26927: LED78.4 LED79.2
$1N27063: LED89.4 LED90.2
$1N27064: LED90.4 LED91.2
$1N27065: LED91.4 LED92.2
$1N27067: LED93.4 LED94.2
$1N27068: LED94.4 LED95.2
$1N27069: LED95.4 LED96.2
$1N27071: LED92.4 LED93.2
$1N27073: LED97.4 LED98.2
$1N27074: LED98.4 LED99.2
$1N27075: LED96.4 LED97.2
$1N27077: LED88.4 LED89.2
$1N29007: LED100.4 LED101.2
$1N29008: LED101.4 LED102.2
$1N29009: LED102.4 LED103.2
$1N29011: LED104.4 LED105.2
$1N29012: LED105.4 LED106.2
$1N29013: LED106.4 LED107.2
$1N29015: LED103.4 LED104.2
$1N29017: LED108.4 LED109.2
$1N29018: LED109.4 LED110.2
$1N29019: LED107.4 LED108.2
$1N29021: LED99.4 LED100.2
$1N29157: LED111.4 LED112.2
$1N29158: LED112.4 LED113.2
$1N29159: LED113.4 LED114.2
$1N29161: LED115.4 LED116.2
$1N29162: LED116.4 LED117.2
$1N29163: LED117.4 LED118.2
$1N29165: LED114.4 LED115.2
$1N29167: LED119.4 LED120.2
$1N29168: LED120.4 LED121.2
$1N29169: LED118.4 LED119.2
$1N29171: LED110.4 LED111.2
$1N29307: LED122.4 LED123.2
$1N29308: LED123.4 LED124.2
$1N29309: LED124.4 LED125.2
$1N29311: LED126.4 LED127.2
$1N29312: LED127.4 LED128.2
$1N29313: LED128.4 LED129.2
$1N29315: LED125.4 LED126.2
$1N29317: LED130.4 LED131.2
$1N29318: LED131.4 LED132.2
$1N29319: LED129.4 LED130.2
$1N29321: LED121.4 LED122.2
$1N29457: LED133.4 LED134.2
$1N29458: LED134.4 LED135.2
$1N29459: LED135.4 LED136.2
$1N29461: LED137.4 LED138.2
$1N29462: LED138.4 LED139.2
$1N29463: LED139.4 LED140.2
$1N29465: LED136.4 LED137.2
$1N29467: LED141.4 LED142.2
$1N29468: LED142.4 LED143.2
$1N29469: LED140.4 LED141.2
$1N29471: LED132.4 LED133.2
$1N29607: LED144.4 LED145.2
$1N29608: LED145.4 LED146.2
$1N29609: LED146.4 LED147.2
$1N29611: LED148.4 LED149.2
$1N29612: LED149.4 LED150.2
$1N29613: LED150.4 LED151.2
$1N29615: LED147.4 LED148.2
$1N29617: LED152.4 LED153.2
$1N29618: LED153.4 LED154.2
$1N29619: LED151.4 LED152.2
$1N29621: LED143.4 LED144.2
$1N29757: LED155.4 LED156.2
$1N29758: LED156.4 LED157.2
$1N29759: LED157.4 LED158.2
$1N29761: LED159.4 LED160.2
$1N29762: LED160.4 LED161.2
$1N29763: LED161.4 LED162.2
$1N29765: LED158.4 LED159.2
$1N29767: LED163.4 LED164.2
$1N29768: LED164.4 LED165.2
$1N29769: LED162.4 LED163.2
$1N29771: LED154.4 LED155.2
$1N29907: LED166.4 LED167.2
$1N29908: LED167.4 LED168.2
$1N29909: LED168.4 LED169.2
$1N29911: LED170.4 LED171.2
$1N29912: LED171.4 LED172.2
$1N29913: LED172.4 LED173.2
$1N29915: LED169.4 LED170.2
$1N29917: LED174.4 LED175.2
$1N29918: LED175.4 LED176.2
$1N29919: LED173.4 LED174.2
$1N29921: LED165.4 LED166.2
$1N31113: LED177.4 LED178.2
$1N31114: LED178.4 LED179.2
$1N31115: LED179.4 LED180.2
$1N31117: LED181.4 LED182.2
$1N31118: LED182.4 LED183.2
$1N31119: LED183.4 LED184.2
$1N31121: LED180.4 LED181.2
$1N31123: LED185.4 LED186.2
$1N31124: LED186.4 LED187.2
$1N31125: LED184.4 LED185.2
$1N31127: LED176.4 LED177.2
$1N31263: LED188.4 LED189.2
$1N31264: LED189.4 LED190.2
$1N31265: LED190.4 LED191.2
$1N31267: LED192.4 LED193.2
$1N31268: LED193.4 LED194.2
$1N31269: LED194.4 LED195.2
$1N31271: LED191.4 LED192.2
$1N31273: LED196.4 LED197.2
$1N31275: LED195.4 LED196.2
$1N31277: LED187.4 LED188.2
$1N31413: LED198.4 LED199.2
$1N31414: LED199.4 LED200.2
$1N31415: LED200.4 LED201.2
$1N31419: LED203.4 LED204.2
$1N31421: LED201.4 LED202.2
$1N31423: LED205.4 LED206.2
$1N31424: LED206.4 LED207.2
$1N31425: LED204.4 LED205.2
$1N31564: LED208.4 LED209.2
$1N31565: LED209.4 LED210.2